# EasyEDA Pro project 智能母版V4.eprj, board PCB1 (continued)
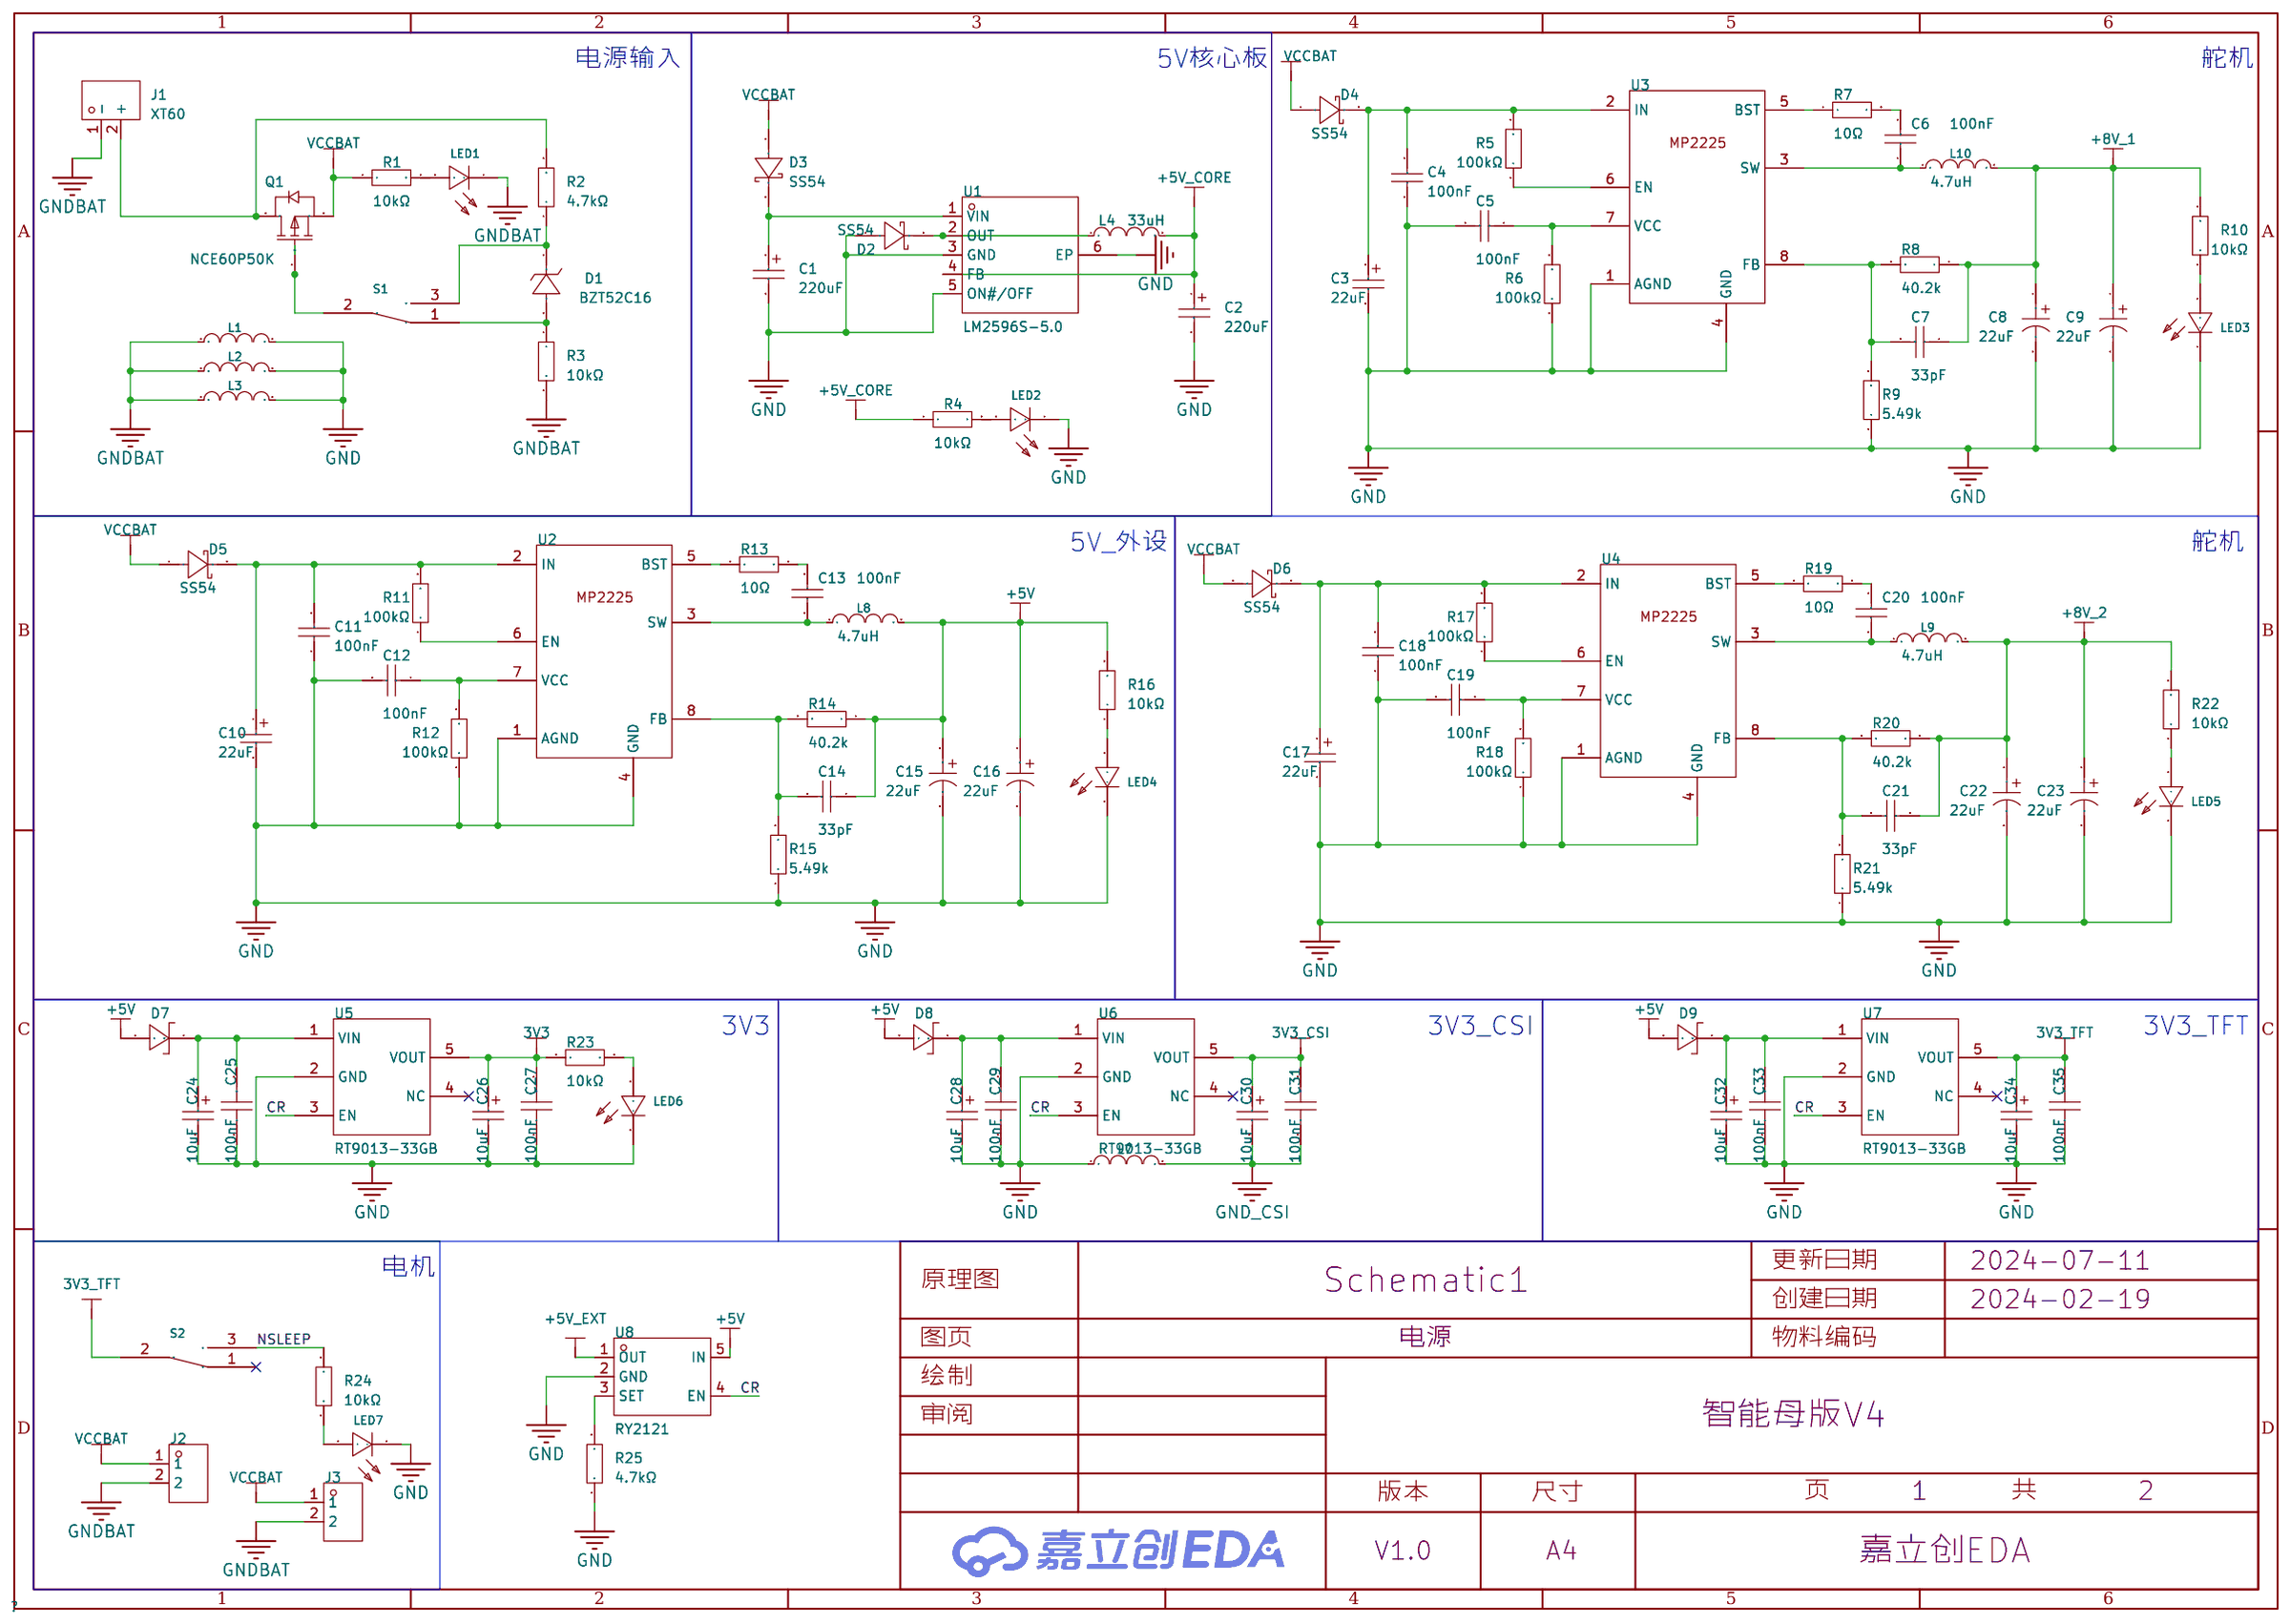
[diagram p0: 电源]
## Routing (per net, layer and track width the routed paths; a pad name or vN(x,y) marks a point on that pad's centre or on a via; arc(x,y) is an arc through that point) (continued)
  Top Layer w0.508: 17.04,37.08 v1(18.41,37.08)
  Top Layer w0.762: H10.2 H12.2 4.83,59.56 5.33,60.07 8.76,60.07 9.53,59.31 9.53,54.74 9.96,54.3 H11.2
  Bottom Layer w0.762: v1(18.41,37.08) 18.41,42.42 16,44.83 11.05,44.83 4.83,51.05 H10.2
+8V_2: length 25.7
  Top Layer w0.381: 24.49,52.8 24.51,52.78 24.51,48.51 23.74,47.74 R20.1 22.65,47.68 C21.1
  Top Layer w0.762: R22.2 18.05,54.1 ; 26.96,66.42 30.23,66.42 33.4,69.6 v1(33.4,77.34)
GND: length 198.1
  Top Layer w0.203: U10.1 v1(73.15,38.61) ; v1(62.1,56.01) 62.97,56.01 63,56.04 ; F1.12 69.44,82.77 v1(69.09,82.42) ; v1(80.01,38.1) 80.01,37.46 79.79,37.24 U10.13 ; R31.2 R30.2 v1(67.69,55.5) 68.58,55.5 68.98,55.1 C36.1 ; U9.7 v1(58.17,52.79) ; U9.10 v1(61.85,54.09) ; U10.4 v1(74.29,35.94) ; v1(70.49,43.69) v1(72.52,43.69) ; v1(75.69,89.03) v1(75.69,86.87) ; U10.10 v1(80.14,35.29) 81.65,35.29 82.15,35.79 R34.2 ; U10.7 v1(74.29,33.99) ; R33.2 v1(69.86,36.18) R32.2 ; U9.1 56.47,56.69 56.01,57.15 v1(54.61,57.15) 54.1,57.15 53.86,56.9 R29.2 52.83,55.88 52.32,55.37 52.32,54.74 52.95,54.11 R28.2 54.61,54.86 56.13,54.86 56.26,54.74 U9.4
  Top Layer w0.381: R21.1 v1(18.03,44.58) ; 7.87,37.59 8,37.72 v1(8,39.62) ; LED4.1 v1(34.66,18.41) ; LED2.1 v1(21.15,65.4) ; 18.92,50.34 v1(18.92,48.89) ; C9.2 v1(14.34,35.06) 14.35,35.05 ; R15.1 v1(19.18,23.88) ; C19.2 v1(19.5,38.35) ; R9.1 v1(1.65,46.74) ; C39.1 60.28,69.64 60.77,69.15 H6.2 ; LED7.1 v1(12.97,20.19) ; Q2.2 v1(38.37,51.18)
  Top Layer w0.508: LED8.1 14.19,88.94 15.75,87.38 17.69,87.38 ; C33.1 44.7,8.08 C32.2 ; C33.1 46.69,8.08 47.21,8.6 U7.2 ; C33.1 v1(46.35,6.6) ; 42.7,16.51 C29.1 ; 42.7,16.51 41.78,16.51 41.19,15.92 C28.2 ; 42.7,16.51 42.76,16.51 ; L7.1 45.32,14.97 45.59,15.24 45.59,16.76 45.09,17.27 U6.2 43.56,17.27 42.8,16.51 42.76,16.51 ; U8.2 40.17,13.04 40.77,12.45 41.38,12.45 41.4,12.47 v1(42.67,12.47) ; LED3.1 16.59,44.49 15.11,45.97 15.11,47.35 H15.3 ; v1(55.75,8.08) C35.1 53.93,8.08 53.42,7.57 C34.2 ; C25.1 42.06,79.74 C24.2 ; C25.1 42.75,79.82 43.16,80.23 47.66,80.23 48.01,79.88 C26.2 48.51,79.51 v1(49.09,79.51) C27.1 50.43,79.24 LED6.1 ; C25.1 42.29,79.67 v1(42.29,78.49) ; 42.76,16.51 v1(42.76,15.24) ; C38.1 C37.1 76.77,54.67 77.09,54.36 v1(77.72,54.36)
  Top Layer w0.762: LED5.1 22.73,55.88 v1(22.73,54.99) ; U1.3 v1(11.56,75.36) ; U1.5 8.94,70.56 9.27,70.23 v1(11.05,70.23)
  Top Layer w0.889: L3.2 L2.2 L1.2 17.27,29.44 v1(17.27,31.5)
  Bottom Layer w0.203: v1(38.35,66.17) 38.35,63.88 v1(38.61,63.63) ; v1(31.75,47.62) 33.53,47.62 v1(34.16,46.99) ; v1(44.32,38.99) v1(42.16,38.99) v1(39.24,38.99) ; v1(28.57,28.83) 30.23,27.18 v1(30.23,26.8) ; v1(56.01,23.49) v1(58.14,23.49) v1(60.2,23.49) ; v1(32.38,41.4) v1(37.85,41.4) ; v1(60.58,43.94) v1(65.41,43.94) v1(67.82,43.94) 70.23,43.94 v1(70.49,43.69) ; v1(52.45,46.23) v1(54.36,46.23) ; v1(60.32,63.5) v1(60.32,65.79) ; v1(63.88,71.5) v1(63.88,74.68) ; v1(60.07,34.04) v1(57.4,34.04) ; v1(2.16,42.42) v1(7.11,42.42) ; v1(65.28,65.4) 65.79,64.9 v1(65.79,63.63) ; v1(30.86,38.61) v1(32.26,37.21)
  Bottom Layer w0.381: v1(1.65,46.74) 1.65,42.93 v1(2.16,42.42) ; v1(8,39.62) 10.03,39.62 11.81,37.85 11.81,35.56 12.32,35.05 14.33,35.05 v1(14.34,35.06) ; v1(12.97,20.19) 15.75,20.19 17.4,21.84 v1(18.54,21.84)
  Bottom Layer w0.508: D2.1 v1(12.44,70.48)
  vias: v1(14.99,61.85) v1(14.99,59.05) v1(15.45,80.26) v1(15.45,75.36) v1(15.45,70.24) v1(17.81,75.36) v1(19.97,75.36) v1(20.94,19.18) v1(23.11,80.26) v1(23.11,70.36) v1(23.18,75.36) v1(24.34,15.9) v1(24.34,15.12) v1(24.34,14.36) v1(24.34,13.58) v1(26.92,86.99) v1(26.92,85.72) v1(30.6,8.82) v1(31.57,8.82) v1(32.56,8.82)
GND_CSI: length 40.8
  Top Layer w0.508: C31.1 50.42,16.06 v1(49.86,16.06) C30.2 48.77,13.84 48.64,13.72 47.25,13.72
  GND w0.381: v1(49.86,16.06) 51.69,16.06 52.07,16.45 52.07,26.16 51.18,27.05 47.75,27.05 46.98,26.28 H1.3
  Bottom Layer w0.203: H1.3 46.98,23.36 46.81,23.19 34.47,23.19 34.28,23.38 H1.13
GNDBAT: length 1.2
  Top Layer w0.889: LED1.1 22.07,8.51 v1(23.24,8.51)
  vias: v1(13.72,29.34)
VCCBAT:
  vias: v1(6.98,62.99) v1(9.02,35.31) v1(9.02,33.27) v1(9.38,62.76) v1(24.76,9.65) v1(25.74,9.65) v1(26.54,9.65) v1(27.69,32.51) v1(27.81,30.48)
B0: length 35.9
  Top Layer w0.203: F1.11 70.94,74.11 69.98,73.15 57.02,73.15 53.59,69.72 v1(53.59,65.53)
  Bottom Layer w0.203: v1(53.59,65.53) 53.59,64.9 52.45,63.75 52.45,62.1
B1: length 43.9
  Top Layer w0.203: v1(56.26,58.42) 52.71,58.42 52.45,58.67 U11.24 ; F1.10 71.94,79.81 71.5,79.37 71.5,72.9 71.25,72.64 57.15,72.64 56.26,71.75 v1(56.26,65.28)
  Bottom Layer w0.203: v1(56.26,65.28) v1(56.26,58.42)
B2: length 40.3
  Top Layer w0.203: v1(69.85,80.01) 69.85,75.18 68.33,73.66 56.01,73.66 53.09,70.74 53.09,66.42 51.94,65.28 v1(50.8,65.28) ; 49.91,62.1 49.91,63.75 50.16,64.01 v1(50.8,64.01) ; F1.9 v1(72.94,80.01)
  Bottom Layer w0.203: v1(50.8,65.28) v1(50.8,64.01) ; v1(72.94,80.01) v1(69.85,80.01)
B3: length 45.3
  Top Layer w0.203: v1(48.77,64.01) v1(48.77,61.59) ; F1.7 74.94,83.87 74.74,84.07 69.88,84.07 66.45,80.64 57.78,80.64 50.67,73.53 v1(50.67,71.5)
  Bottom Layer w0.203: U11.26 49.91,60.58 49.66,60.83 49.15,60.83 48.77,61.21 v1(48.77,61.59) ; v1(48.77,64.01) 48.77,64.52 50.67,66.42 v1(50.67,71.5)
B9: length 55.2
  Top Layer w0.203: v1(37.21,46.23) 37.21,31.62 ; v1(29.59,54.99) 29.59,62.1 32.38,64.9 43.05,64.9 44.47,66.31 CN1.3
  Bottom Layer w0.203: v1(29.59,54.99) 29.59,48.39 31.75,46.23 v1(37.21,46.23)
B10: length 52.7
  Top Layer w0.203: CN1.4 46.97,65.13 46.15,64.31 34.47,64.31 33.4,63.25 v1(33.4,40.26)
  Bottom Layer w0.203: U11.48 34.54,28.96 33.78,28.96 33.4,29.34 v1(33.4,40.26)
B11: length 56.6
  Top Layer w0.203: v1(57.4,44.7) v1(57.4,38.48) ; U10.2 73.12,37.21 72.26,37.21 72.14,37.08 R33.1 70.74,37.08 70.61,37.21 v1(70.61,38.48)
  Bottom Layer w0.203: U11.47 34.67,32.89 34.93,33.15 36.07,33.15 36.58,33.65 36.58,35.56 35.31,36.83 35.31,37.97 39.12,41.78 50.8,41.78 51.44,42.42 52.96,42.42 55.25,44.7 v1(57.4,44.7) ; v1(70.61,38.48) v1(57.4,38.48)
B11_A: length 84.1
  Top Layer w0.203: v1(37.97,48.39) 39.75,48.39 v1(41.91,46.23) ; v1(74.29,40.26) 74.29,36.83 74.06,36.59 73.15,36.59 ; v1(72.26,40.89) v1(70.49,40.89) ; v1(15.11,56.01) 15.11,52.47 H15.1 ; v1(46.61,40.51) v1(46.61,46.23) ; v1(32.64,44.96) v1(32.64,49.4)
  Bottom Layer w0.203: v1(74.29,40.26) 73.66,40.89 v1(72.26,40.89) ; v1(32.64,49.4) 34.29,49.4 35.31,48.39 v1(37.97,48.39) ; v1(15.11,56.01) 15.92,56.01 26.97,44.96 v1(32.64,44.96) ; v1(46.61,40.51) 48.01,40.51 48.26,40.26 57.91,40.26 58.29,40.64 70.23,40.64 v1(70.49,40.89) ; v1(41.91,46.23) v1(46.61,46.23)
B12: length 55.3
  Top Layer w0.203: 58.59,13.59 58.59,17.49 57.53,18.54 57.53,25.27 56.51,26.29 56.51,47.24 v1(50.42,53.34)
  Bottom Layer w0.203: v1(50.42,53.34) 50.42,57.28 48.64,59.05 48.64,60.07 48.01,60.71 47.35,60.71 45.95,62.1 44.83,62.1
B13: length 63.9
  Top Layer w0.203: CN2.3 61.09,12.06 60.58,11.56 58.04,11.56 57.4,12.19 57.4,16.38 53.72,20.07 53.72,48.51 51.18,51.05
  Bottom Layer w0.203: 47.37,62.1 47.37,63.17 47.57,63.37 50.67,63.37 51.05,62.99 v1(51.05,51.18)
B14: length 51.8
  Top Layer w0.203: v1(45.85,61.34) v1(45.85,63.12) ; v1(45.72,69.85) 47.24,69.85 49.78,72.39 49.78,73.41 57.4,81.03 66.29,81.03 69.85,84.58 77.6,84.58 77.94,84.24 F1.4
  Bottom Layer w0.203: U11.30 45.72,59.56 45.85,59.69 v1(45.85,61.34) ; v1(45.85,63.12) 45.72,63.25 v1(45.72,69.85)
B15: length 29
  Top Layer w0.203: CN1.6 51.97,70.2 51.44,70.74 48.9,70.74 48.26,70.1 48.26,65.02 46.99,63.75 v1(43.56,63.75)
  Bottom Layer w0.203: v1(43.56,63.75) 43.56,57.53 43.94,57.15 46.86,57.15 47.37,57.66 47.37,59.56
B16: length 92.2
  Top Layer w0.203: H4.3 61.09,7.24 v1(62.36,8.51) ; v1(42.29,57.15) v1(42.29,47.12)
  Bottom Layer w0.203: v1(42.29,57.15) U11.32 ; v1(62.36,8.51) 62.36,23.62 63.12,24.38 70.87,24.38 71.5,25.02 71.5,45.72 70.1,47.12 v1(42.29,47.12)
B17: length 109.1
  Top Layer w0.203: 42.29,62.1 42.29,61.09 42.8,60.58 v1(53.85,60.58) ; H4.4 61.09,0.89 61.47,0.51 64.52,0.51 64.9,0.89 64.9,6.86 67.06,9.02 75.06,9.02 77.22,11.18 77.22,24.26 79.12,26.16 v1(79.12,33.27)
  Bottom Layer w0.203: v1(79.12,33.27) 79.12,46.86 78.36,47.62 60.71,47.62 53.85,54.48 v1(53.85,60.58)
B18: length 50.2
  Top Layer w0.203: CN3.4 58.77,46.01 46.86,57.91 40.26,57.91 39.75,58.42 U11.34
B19: length 54
  Top Layer w0.203: 39.75,62.1 40.64,62.1 41.02,61.72 41.02,58.8 41.4,58.42 47.37,58.42 61.27,44.52 CN3.3
B20: length 38.5
  Top Layer w0.203: H1.15 31.74,27.19 30.48,28.45 30.48,36.32 35.76,41.6 35.76,55.32 37.21,56.77 37.21,59.56
B21: length 9.1
  Top Layer w0.203: R27.1 38.62,61.71 38.23,62.1 37.21,62.1
B22: length 41.2
  Top Layer w0.203: v1(36.96,55.24) 36.96,48.01 37.21,47.75 39.5,47.75 43.31,43.94 43.31,27.69 44.44,26.55 H1.5
  Bottom Layer w0.203: v1(36.96,55.24) 36.96,57.28 35.94,58.29 35.94,59.31 35.69,59.56 U11.38
B23: length 63.5
  Top Layer w0.203: v1(54.74,79.63) 56.51,81.41 66.17,81.41 69.72,84.96 78.23,84.96 78.94,84.26 F1.3
  Bottom Layer w0.203: v1(54.74,79.63) 54.74,73.41 53.47,72.14 38.61,72.14 36.58,70.1 36.58,64.01 36.32,63.75 35.05,63.75 34.67,63.37 34.67,62.1
B24: length 60.5
  Top Layer w0.203: U11.40 31.24,59.56 30.84,59.16 30.84,43.84 v1(30.86,43.81) ; H1.2 50.8,21.84 51.18,22.22 v1(51.18,43.81)
  Bottom Layer w0.203: v1(51.18,43.81) v1(30.86,43.81)
B25: length 61.3
  Top Layer w0.203: v1(30.23,42.42) 30.23,61.34 30.99,62.1 32.13,62.1 ; v1(48.51,42.42) 48.46,42.37 48.46,26.62 48.26,26.42 48.26,21.97 48.13,21.84 H1.4
  Bottom Layer w0.203: v1(48.51,42.42) v1(30.23,42.42)
B26: length 56.8
  Top Layer w0.203: H1.6 45.59,21.84 45.72,21.97 45.72,27.18 45.92,27.38 45.92,56.51
  Bottom Layer w0.203: v1(45.97,56.51) 39.62,56.51 38.61,57.53 38.61,60.45 38.23,60.83 33.66,60.83 33.4,60.58 33.4,57.28 33.15,57.02 32.13,57.02
B27: length 41.8
  Top Layer w0.203: H1.8 40.77,21.84 40.64,21.97 v1(40.64,26.03) ; v1(40.64,27.94) 40.64,28.57 41.15,29.08 41.15,44.7 38.99,46.86 v1(36.7,46.86) ; v1(34.04,48.39) v1(34.04,54.74)
  Bottom Layer w0.203: 34.67,57.02 34.67,55.37 v1(34.04,54.74) ; v1(40.64,26.03) v1(40.64,27.94) ; v1(34.04,48.39) 35.56,46.86 v1(36.7,46.86)
B28: length 14.2
  Top Layer w0.203: v1(38.1,26.16) 38.1,22.1 38.35,21.84 H1.10
  Bottom Layer w0.203: U11.46 32.13,26.42 32.38,26.16 v1(38.1,26.16)
B29: length 22.9
  Top Layer w0.203: v1(29.59,31.62) 29.59,20.57 30.35,19.81 36.45,19.81 36.82,20.18 H1.12
  Bottom Layer w0.203: v1(29.59,31.62) U11.45
B30: length 20.9
  Top Layer w0.203: U11.43 32.13,35.56 33.02,36.45 35.05,36.45 35.94,35.56 35.94,27.56 35.56,27.18 35.56,22.1 35.31,21.84 H1.14
B31: length 14.2
  Top Layer w0.203: U11.44 34.67,33.15 33.4,31.88 33.4,27.05 33.02,26.67 33.02,21.97 32.89,21.84 H1.16
C0: length 94.5
  Top Layer w0.203: v1(83.06,27.94) v1(83.06,63.5) ; v1(69.09,79.12) v1(63.75,79.12)
  Bottom Layer w0.203: v1(69.09,79.12) 69.09,71.37 69.6,70.87 76.45,70.87 77.6,69.72 77.6,65.66 78.1,65.15 81.41,65.15 v1(83.06,63.5) ; v1(63.75,79.12) 63.75,80.77 62.48,82.04 49.53,82.04 48.64,82.93 H3.3 ; U11.82 77.85,28.19 78.1,27.94 v1(83.06,27.94)
C1: length 100.8
  Top Layer w0.203: H3.4 48.64,86.87 48.9,86.61 53.21,86.61 54.23,85.6 54.23,84.2 54.53,83.9 66.09,83.9 66.55,83.44 v1(66.55,82.8) ; v1(85.34,32.64) v1(85.34,77.47)
  Bottom Layer w0.203: U11.79 75.31,32.38 75.56,32.64 v1(85.34,32.64) ; v1(66.55,82.8) 66.55,81.28 67.06,80.77 84.46,80.77 85.34,79.88 v1(85.34,77.47)
C2: length 100.3
  Top Layer w0.203: v1(84.46,26.42) 84.46,65.28 83.31,66.42 81.53,66.42 79.25,68.71 79.25,72.14 83.19,76.07 v1(83.19,81.41)
  Bottom Layer w0.203: U11.80 75.31,26.92 75.82,26.42 v1(84.46,26.42) ; H2.3 60.71,86.36 61.09,86.74 68.96,86.74 69.98,87.76 80.65,87.76 83.19,85.22 v1(83.19,81.41)
C3: length 28.8
  Top Layer w0.203: v1(73.66,8.25) H5.3
  Bottom Layer w0.203: v1(73.66,8.25) 74.8,9.4 74.8,24.64 73.78,25.67 73.78,31.42 73.57,31.62 U11.77
C6: length 10.2
  Top Layer w0.203: v1(70.87,32.77) 71.5,32.13 71.5,29.34 71.25,29.08 U11.76 ; v1(70.61,34.42) 70.61,35.18 70.74,35.31 R32.1 73.13,35.31 U10.5
  Bottom Layer w0.203: v1(70.87,32.77) 70.61,33.02 v1(70.61,34.42)
C6_A: length 95.4
  Top Layer w0.203: H14.1 20.57,62.61 20.19,62.23 20.19,58.8 19.69,58.29 17.02,58.29 16.76,58.04 v1(16.76,56.26) ; v1(63.88,51.76) 75.74,51.76 75.95,51.56 75.95,35.31 75.28,34.64 U10.6 ; v1(55.37,51.94) v1(60.96,51.94)
  Bottom Layer w0.203: v1(16.76,56.26) 29.97,56.26 30.61,55.63 30.61,51.87 31.88,50.6 36.07,50.6 37.01,49.66 53.09,49.66 v1(55.37,51.94) ; v1(63.88,51.76) 63.7,51.94 v1(60.96,51.94)
C11: length 103.3
  Top Layer w0.203: H8.1 39.75,87.88 44.32,83.31 v1(65.53,83.31) ; v1(77.72,51.82) v1(77.72,42.04) ; U11.69 62.48,31.75 62.48,33.4 62.99,33.91 66.8,33.91 67.18,34.29 67.18,36.19 68.2,37.21 68.2,39.75 70.49,42.04 v1(72.26,42.04)
  Bottom Layer w0.203: v1(77.72,51.82) 76.58,52.96 76.58,64.39 75.82,65.15 68.33,65.15 67.18,66.29 67.18,69.72 65.53,71.37 v1(65.53,83.31) ; v1(77.72,42.04) v1(72.26,42.04)
C16: length 27.2
  Top Layer w0.203: CN4.4 70.83,14.76 68.2,17.4 68.2,26.03 66.68,27.56 v1(62.74,27.56)
  Bottom Layer w0.203: v1(62.74,27.56) 57.91,27.56 57.53,27.94 U11.66
C17: length 34.1
  Top Layer w0.203: v1(64.01,33.27) 68.71,33.27 68.96,33.02 68.96,27.3 70.61,25.65 70.61,17.65 71,17.26 CN4.3
  Bottom Layer w0.203: U11.63 54.99,32.77 55.5,33.27 v1(64.01,33.27)
C18: length 83.3
  Top Layer w0.203: v1(77.72,39.24) 79.12,39.24 82.04,42.16 82.04,62.99 81.15,63.88 79.76,63.88 78.74,64.9 78.74,78.36 75.94,81.16 F1.6 ; v1(54.99,39.12) 54.99,34.42 56.13,33.27 56.13,31.11 54.99,29.97 U11.64 ; v1(72.26,39.24) v1(70.61,39.24)
  Bottom Layer w0.203: v1(54.99,39.12) 70.49,39.12 v1(70.61,39.24) ; v1(77.72,39.24) v1(72.26,39.24)
C19: length 78.6
  Top Layer w0.203: v1(52.45,41.78) U11.61 ; v1(61.47,45.85) 61.47,48.26 v1(61.59,48.39) ; F1.8 73.94,80.75 74.29,80.39 76.2,80.39 78.23,78.36 78.23,64.26 79.12,63.37 v1(79.12,48.39)
  Bottom Layer w0.203: v1(52.45,41.78) 55.37,41.78 59.44,45.85 v1(61.47,45.85) ; v1(79.12,48.39) v1(61.59,48.39)
C20: length 59.4
  Top Layer w0.203: v1(74.04,49.53) 74.04,41.27 72.64,39.88 70.36,39.88 68.83,38.35 v1(68.83,36.58) ; v1(64.39,36.58) v1(64.39,34.8) ; v1(74.04,53.34) 74.04,62.74 70.93,65.85 H6.6
  Bottom Layer w0.203: v1(68.83,36.58) v1(64.39,36.58) ; U11.62 53.72,29.08 53.97,29.34 53.97,33.91 54.86,34.8 v1(64.39,34.8) ; v1(74.04,53.34) v1(74.04,49.53)
C21: length 60.6
  Top Layer w0.203: H6.5 68.39,66.11 71.5,62.99 71.5,58.93 72.9,57.53 v1(72.9,53.34) ; v1(50.55,36.58) 50.55,33.65 49.91,33.02 U11.59 ; v1(63.12,36.58) v1(63.12,49.53)
  Bottom Layer w0.203: v1(63.12,36.58) v1(50.55,36.58) ; v1(72.9,53.34) 72.9,49.91 72.52,49.53 v1(63.12,49.53)
C22: length 58.2
  Top Layer w0.203: v1(67.31,51.18) 67.18,51.05 v1(67.18,37.72) ; v1(66.42,65.28) 65.85,65.85 65.85,67.94 ; v1(49.91,37.72) 49.91,34.29 48.8,33.18 48.8,29.3 49.02,29.08 U11.60
  Bottom Layer w0.203: v1(67.18,37.72) v1(49.91,37.72) ; v1(67.31,51.18) 67.31,52.07 66.42,52.96 v1(66.42,65.28)
C23: length 66.6
  Top Layer w0.203: v1(63.31,63.57) 63.31,63.06 63.88,62.48 63.88,58.67 62.99,57.78 52.45,57.78 51.56,56.9 51.56,54.86 61.98,44.45 v1(61.98,39.88) ; v1(47.5,39.75) 47.5,31.75 47.37,31.62 ; H6.3 v1(63.31,65.53)
  Bottom Layer w0.203: v1(47.5,39.75) 61.85,39.75 v1(61.98,39.88) ; v1(63.31,65.53) v1(63.31,63.57)
C24: length 102.6
  Top Layer w0.203: v1(68.58,51.18) v1(68.58,42.16) ; v1(68.33,81.53) v1(68.33,79.88) ; v1(69.72,65.91) v1(71.88,63.75) ; v1(70.87,86.74) 70.87,89.28 70.61,89.53 60.96,89.53 60.71,89.28 H2.4 ; 47.37,29.08 47.37,30.2 46.35,31.22 46.35,32.77 46.74,33.15 v1(46.74,36.19)
  Bottom Layer w0.203: v1(71.88,63.75) 69.72,63.75 68.96,62.99 68.96,52.7 68.58,52.32 v1(68.58,51.18) ; v1(68.58,42.16) 57.15,42.16 56.21,41.22 45.92,41.22 45.09,40.39 45.09,36.58 45.47,36.19 v1(46.74,36.19) ; v1(68.33,79.88) 68.33,70.74 69.72,69.34 v1(69.72,65.91) ; v1(70.87,86.74) 70.87,82.3 70.1,81.53 v1(68.33,81.53)
C25: length 80.2
  Top Layer w0.203: v1(67.82,35.56) 69.98,33.4 v1(72.52,33.4) ; H5.4 73.66,0.89 73.91,0.63 77.6,0.63 77.98,1.02 77.98,23.62 81.91,27.56 v1(81.91,30.35)
  Bottom Layer w0.203: v1(72.52,33.4) 73.53,33.4 74.17,32.77 74.17,30.99 74.8,30.35 v1(81.91,30.35) ; v1(67.82,35.56) 45.97,35.56 44.83,34.42 U11.55
C26: length 95.1
  Top Layer w0.203: U11.56 44.83,30.1 43.69,31.24 v1(43.69,45.47) ; v1(75.06,51.05) 69.98,51.05 69.22,50.29 v1(69.22,46.48) ; v1(79.88,77.32) 79.88,80.31 R26.1 79.94,80.37 F1.2
  Bottom Layer w0.203: v1(43.69,45.47) 57.66,45.47 58.67,46.48 v1(69.22,46.48) ; v1(75.06,51.05) 81.53,51.05 83.95,53.47 83.95,64.39 82.42,65.91 80.9,65.91 79.25,67.56 79.25,76.71 79.88,77.34
C27: length 41.6
  Top Layer w0.203: H7.5 v1(52.96,2.03) ; v1(52.96,27.56) v1(52.96,13.72)
  Bottom Layer w0.203: U11.53 42.29,30.73 42.42,30.61 50.04,30.61 50.93,29.72 50.93,28.32 51.69,27.56 v1(52.96,27.56) ; v1(52.96,2.03) v1(52.96,13.72)
C28: length 6.5
  Top Layer w0.203: H1.9 39.36,25.77 40.64,27.05 41.66,27.05 42.29,27.69 U11.54
C29: length 8.5
  Top Layer w0.203: H1.11 36.82,26.15 38.74,28.07 38.74,29.49 39.75,30.5 U11.51
C30: length 42.4
  Top Layer w0.203: H7.1 44.2,2.03 43.56,2.67 v1(43.56,6.1)
  Bottom Layer w0.203: U11.52 39.75,29.46 40.37,30.09 48.02,30.09 48.39,29.72 48.39,27.05 48.21,26.87 48.21,20.9 47.75,20.45 44.7,20.45 43.56,19.3 v1(43.56,6.1)
C31: length 72.6
  Top Layer w0.203: v1(36.45,45.59) 36.45,36.96 v1(36.32,36.83) ; H8.5 34.04,87.88 34.29,87.63 34.29,83.06 36.07,81.28 36.07,70.87 28.83,63.63 v1(28.83,54.99)
  Bottom Layer w0.203: 37.21,29.08 38.1,29.08 38.35,29.34 38.35,36.32 37.85,36.83 v1(36.32,36.83) ; v1(28.83,54.99) 28.83,48.13 31.37,45.59 v1(36.45,45.59)
CR: length 170.2
  Top Layer w0.203: 43.96,13.97 43.96,12.3 44.58,11.68 48.64,11.68 49.66,10.67 49.66,8.13 49.18,7.65 U7.3 ; 43.96,13.97 42.93,13.97 42.04,14.86 37.47,14.86 37.05,14.45 U8.4 ; 43.96,13.97 44.58,14.59 v1(44.58,15.6) 44.58,16.31 U6.3 ; R35.2 R36.2 71.26,55.26 70.99,54.99 70.99,54.1 C36.2 71.99,54.08 72.26,54.36 v1(72.26,54.99) ; 43.99,79.28 v1(43.99,78.61) ; v1(59.94,44.58) v1(59.94,41.53)
  PWR w0.203: v1(52.07,77.09) 52.07,75.69 54.86,72.9 76.71,72.9 77.47,72.14 77.47,66.42 76.58,65.53 76.58,58.17 75.82,57.4 74.68,57.4 v1(72.26,54.99) 70.1,54.99 69.72,54.61 65.15,54.61 64.9,54.86 60.85,54.86 59.94,53.96 59.94,51.43 62.87,48.51 69.72,48.51 70.49,47.75 70.49,45.47 69.6,44.58 v1(59.94,44.58) ; v1(59.94,41.53) 59.44,41.53 58.8,40.89 58.8,26.8 57.02,25.02 53.97,25.02 53.59,24.64 53.59,19.05 53.47,18.92 50.42,18.92 49.53,19.81 v1(47.12,19.81)
  Bottom Layer w0.203: v1(47.12,19.81) 45.59,19.81 44.58,18.8 v1(44.58,15.6) ; v1(52.07,77.09) 50.42,77.09 49.91,77.6 44.32,77.6 43.99,77.93 v1(43.99,78.61)
D0: length 13.9
  Top Layer w0.203: U11.14 65.15,58.42 64.01,57.28 59.06,57.28 58.04,56.26 58.04,54.36 57.78,54.1 57.16,54.1 U9.5 57.12,54.11 R28.1
D0_A: length 63.8
  Top Layer w0.203: v1(54.36,52.96) 55.75,52.96 56.23,53.44 U9.6
  Bottom Layer w0.203: v1(54.36,52.96) 53.09,52.96 52.32,52.2 52.32,50.67 51.82,50.16 37.08,50.16 36.32,50.93 32.13,50.93 31.12,51.94 31.12,55.75 29.97,56.9 14.48,56.9 13.21,55.63 2.67,55.63 2.29,55.24 H10.1
D1: length 12.8
  Top Layer w0.203: U9.9 63.03,53.47 64.01,53.47 64.26,53.72 R31.1 v1(65.66,53.72)
  Bottom Layer w0.203: v1(65.66,53.72) 65.66,54.48 65.02,55.12 65.02,57.45 63.88,58.6 63.88,60.45 64.26,60.83 64.9,60.83 65.15,61.09 65.15,62.1
D1_A: length 62
  Top Layer w0.203: H11.1 13.52,56.84 14.1,56.26 v1(14.1,55.24) ; U9.8 63,51.06 61.85,49.91 60.83,49.91 v1(59.18,48.26)
  Bottom Layer w0.203: v1(14.1,55.24) 16.26,55.24 27.13,44.37 38.41,44.37 42.29,48.26 v1(59.18,48.26)
D2: length 16.9
  Top Layer w0.203: v1(64.01,56.64) 66.8,56.64 67.69,57.53 U11.12 ; R29.1 56.13,55.88 v1(56.26,56.01) 57.12,56.01 57.15,56.04 ; v1(60.71,56.64) v1(59.31,56.64)
  Bottom Layer w0.203: v1(56.26,56.01) 56.26,56.77 56.77,57.28 58.67,57.28 v1(59.31,56.64) ; v1(60.71,56.64) v1(64.01,56.64)
D2_A: length 66.1
  Top Layer w0.203: U9.3 56.06,55.39 55.86,55.18 53.03,55.18 v1(52.96,55.12) ; v1(51.69,58.04) v1(48.64,58.04)
  Bottom Layer w0.203: v1(48.64,58.04) 48.64,56.01 47.88,55.24 38.99,55.24 37.59,53.85 33.89,53.85 30.46,57.28 14.35,57.28 10.67,60.96 2.79,60.96 2.29,60.45 H12.1 ; v1(52.96,55.12) 52.96,57.4 52.32,58.04 v1(51.69,58.04)
D3: length 10.7
  Top Layer w0.203: v1(65.66,55.5) R30.1 63.88,55.5 63.75,55.37 63.01,55.37 U9.12 ; 67.69,62.1 66.8,62.1 66.42,61.72 66.42,58.17 v1(65.79,57.53)
  Bottom Layer w0.203: v1(65.66,55.5) 65.66,57.4 v1(65.79,57.53)
D3_A: length 53.2
  Top Layer w0.203: v1(58.8,51.31) v1(56.01,51.31) ; v1(24.13,55.63) 24.13,57.28 23.62,57.78 22.1,57.78 21.95,57.93 H13.1 ; U9.11 v1(58.8,54.74)
  Bottom Layer w0.203: v1(56.01,51.31) 53.97,49.28 36.7,49.28 35.69,50.29 31.62,50.29 30.23,51.69 30.23,55.24 29.84,55.63 v1(24.13,55.63) ; v1(58.8,54.74) v1(58.8,51.31)
D4: length 27.7
  Top Layer w0.203: CN1.5 49.47,65.72 50.55,64.64 67.56,64.64 68.96,63.25 68.96,59.82 69.22,59.56 U11.10
D12: length 49.7
  Top Layer w0.203: v1(64.64,82.68) 43.81,82.68 41.15,85.34 H8.2
  Bottom Layer w0.203: v1(64.64,82.68) 64.64,63.12 63.63,62.1 62.61,62.1
D13: length 56
  Top Layer w0.203: v1(33.02,81.66) H8.6 ; v1(61.34,64.01) 61.34,59.94 61.72,59.56 U11.16
  Bottom Layer w0.203: v1(61.34,64.01) 61.72,64.01 62.1,64.39 62.1,71.75 62.87,72.52 62.87,79.12 60.32,81.66 v1(33.02,81.66)
D14: length 94.2
  Top Layer w0.203: v1(64.64,52.7) 75.44,52.7 76.45,51.69 76.45,11.56 74.8,9.91 59.82,9.91 54.48,4.57 H7.6
  Bottom Layer w0.203: v1(64.64,52.7) 64.64,57.15 64.01,57.78 62.1,57.78 61.34,58.55 61.34,61.85 61.09,62.1 60.07,62.1
D15: length 76.4
  Top Layer w0.203: v1(66.55,34.67) v1(66.55,51.18) ; H7.2 v1(45.47,6.6)
  Bottom Layer w0.203: v1(66.55,34.67) 66.55,27.3 65.91,26.67 54.61,26.67 52.45,24.51 52.45,15.62 45.47,8.64 v1(45.47,6.6) ; v1(66.55,51.18) 60.71,51.18 60.07,51.82 U11.18
D16: length 30.6
  Top Layer w0.203: v1(55.63,66.04) v1(55.63,67.94) ; v1(49.91,75.31) 41.4,75.31 41.02,74.93 H9.1 ; v1(55.63,75.31) v1(53.97,75.31)
  Bottom Layer w0.203: v1(55.63,75.31) v1(55.63,67.94) ; v1(55.63,66.04) 57.02,66.04 57.53,65.53 57.53,62.1 ; v1(49.91,75.31) v1(53.97,75.31)
D17: length 27.4
  Top Layer w0.203: v1(46.86,70.74) 43.94,70.74 43.56,71.12 H9.3 ; v1(51.31,69.85) v1(49.15,69.85)
  Bottom Layer w0.203: v1(46.86,70.74) 48.26,70.74 v1(49.15,69.85) ; v1(51.31,69.85) 52.71,69.85 56.01,66.55 57.78,66.55 58.8,65.53 58.8,59.82 58.55,59.56 U11.20
D26: length 88.7
  Top Layer w0.203: v1(80.65,41.66) 81.41,42.42 v1(81.41,52.2) ; v1(52.71,77.98) 44.07,77.98 43.56,77.47 H9.4 ; v1(62.23,78.74) 65.53,75.44 v1(67.06,75.44) ; v1(67.06,71.12) 74.8,71.12 77.34,68.58 v1(77.34,64.13) ; v1(81.53,33.53) 81.53,31.35 80.39,30.2 U11.84
  Bottom Layer w0.203: v1(80.65,41.66) 80.65,36.45 81.53,35.56 v1(81.53,33.53) ; v1(67.06,75.44) v1(67.06,71.12) ; v1(77.34,64.13) 80.52,64.13 81.41,63.25 v1(81.41,52.2) ; v1(62.23,78.74) 60.58,80.39 53.21,80.39 52.71,79.88 v1(52.71,77.98)
D27: length 8.3
  Top Layer w0.203: R34.1 77.61,36.59 77.34,36.32 77.34,32.13 U11.81
D27_A: length 102
  Top Layer w0.203: v1(35.18,49.66) 35.18,55.63 35.81,56.26 35.81,62.99 36.58,63.75 v1(37.47,63.75) ; v1(37.47,69.6) v1(37.47,75.44) ; v1(75.31,38.61) v1(75.31,50.29) v1(71.12,50.29) ; U10.11 v1(77.98,35.94) ; v1(30.23,83.44) R37.1 ; v1(57.02,50.29) v1(58.93,50.29)
  Bottom Layer w0.203: v1(57.02,50.29) 55.68,48.95 35.89,48.95 v1(35.18,49.66) ; v1(75.31,38.61) 77.47,38.61 77.98,38.1 v1(77.98,35.94) ; v1(37.47,75.44) 31.12,75.44 30.23,76.33 v1(30.23,83.44) ; v1(37.47,63.75) v1(37.47,69.6) ; v1(71.12,50.29) v1(58.93,50.29)
NSLEEP: length 161.9
  Top Layer w0.381: 11.81,27.3 11.81,24.64 11.18,24 8.64,24 8.13,23.5 R24.2
  PWR w0.508: H8.4 35.56,83.69 35.18,83.31 32.38,83.31 29.97,80.9 29.97,59.18 27.05,56.26 27.05,43.18 24.89,41.02 13.33,41.02 11.81,39.5 S2.3 10.29,27.3 9.53,28.07 9.53,29.97 8.76,30.73 5.21,30.73 4.44,29.97 4.44,25.27 8.13,21.59 8.13,18.92 11.18,15.88 19.94,15.88 22.1,18.03 26.54,18.03 27.81,16.76 46.86,16.76 48.01,15.62 H7.4
$1N429: length 19.5
  Top Layer w0.889: D1.1 15.13,13.08
  Bottom Layer w0.889: v1(15.13,13.22) 15.13,14.97 14.1,16 3.43,16 2.41,14.98 S1.3
$1N432: length 2.3
  Top Layer w0.889: Q1.1 v1(16.76,6.34)
$1N517: length 1.7
  Top Layer w0.889: LED1.2 20.4,8.5 R1.2
$1N6580: length 6.5
  Top Layer w0.508: 43.99,81.18 43.96,81.22 C25.2 41.21,81.22 40.29,82.14 C24.1 39.08,82.14 38.64,81.69 D7.1
$1N6622: length 1.7
  Top Layer w0.508: LED6.2 53.59,79.3 R23.2
$1N7021: length 6.3
  Top Layer w0.508: D8.1 40.49,18.29 C28.1 41.62,18.32 41.91,18.03 42.7,18.03 C29.2 43.01,18.22 U6.1
$1N10122: length 1.8
  Top Layer w0.381: LED7.2 11.34,21.62 R24.1
$1N19893: length 12.9
  Top Layer w0.762: U1.2 11.14,77.06 11.68,77.6 14.08,77.6 v1(14.1,77.61)
  Bottom Layer w0.508: 12.46,77.61 v1(14.1,77.61)
  Bottom Layer w0.762: v1(14.1,77.61) 16.4,77.61 16.97,78.18 L4.1
$1N25035: length 2
  Top Layer w0.762: U1.1 v1(8.94,80.77)
  vias: v1(9.78,68.71) v1(9.78,67.94) v1(9.78,67.06)
$1N25690: length 3.4
  Top Layer w0.381: R11.1 25.19,23.62 23.5,23.62 23.19,23.31 U2.6
$1N25691: length 5.7
  Top Layer w0.381: U2.7 22.53,21.5 21.99,20.95 21.97,20.95 21.6,20.58 R12.2 19.62,20.52 C12.1
$1N25693: length 5.8
  Top Layer w0.381: 19.94,25.83 21.89,25.83 R14.2 21.96,25.76 R15.2 21.88,23.8 21.88,22.04
$1N25694: length 1.9
  Top Layer w0.381: R13.2 27.41,25.38 C13.2
$1N25695: length 3.4
  Top Layer w0.381: U2.5 23.88,22.08 v1(23.88,22.86) ; v1(23.88,24.38) 24.01,24.52 R13.1
  Bottom Layer w0.381: v1(23.88,22.86) v1(23.88,24.38)
$1N25841: length 14
  Top Layer w0.381: v1(19.94,17.65) 22.51,17.65 22.54,17.63 ; R11.2 26.53,22.11 v1(26.54,22.1)
  Bottom Layer w0.381: v1(26.54,22.1) 24.13,22.1 22.86,20.83 20.32,20.83 19.94,20.45 v1(19.94,17.65)
  vias: v1(19.94,12.7) v1(20.7,12.7) v1(21.46,12.7)
$1N26497: length 12.5
  Top Layer w0.381: R17.1 28.31,40.5 v1(28.32,40.51) ; U4.6 24.2,43.81 24,43.81 23.62,44.2 23.62,45.59 23.88,45.85 v1(24.76,45.85)
  Bottom Layer w0.381: v1(28.32,40.51) 28.32,42.29 v1(24.76,45.85)
$1N26498: length 5.2
  Top Layer w0.381: C19.1 21.16,41.47 R18.2 22.34,41.52 22.73,41.91 23.37,41.91 23.55,42.1 U4.7
$1N26500: length 5.4
  Top Layer w0.381: C21.2 20.75,46.24 R20.2 22.65,46.18 R21.2 22.61,44.53 22.61,43.81 22.9,43.52 U4.8
$1N26501: length 2.2
  Top Layer w0.381: C20.2 28.18,44.7 R19.2
$1N26502: length 1.9
  Top Layer w0.381: R19.1 24.85,44.3 U4.5
$1N26503: length 1.6
  Top Layer w0.762: 19.55,55.88 21.13,55.88 LED5.2
$1N26528: length 8.9
  Top Layer w0.381: v1(26.92,37.85) 26.89,37.88 R17.2 ; 23.25,37.85 v1(21.21,37.85)
  Bottom Layer w0.381: v1(21.21,37.85) v1(26.92,37.85)
$1N27191: length 4.3
  Top Layer w0.381: v1(7.11,46.86) 8.08,46.86 R5.1 ; U3.6 v1(5.8,46.86)
  Bottom Layer w0.381: v1(5.8,46.86) v1(7.11,46.86)
$1N27192: length 5
  Top Layer w0.381: C5.1 3,44.01 R6.2 4.08,44.06 4.32,43.81 5.08,43.81 5.15,43.89 U3.7
$1N27194: length 5.8
  Top Layer w0.381: 4.5,46.66 4.43,46.74 ; 4.5,46.66 U3.8 ; 4.5,46.66 4.5,48.4 R8.2 2.66,48.45 C7.2
$1N27195: length 1.9
  Top Layer w0.381: R7.2 9.71,48.64 9.78,48.58
$1N27196: length 3.8
  Top Layer w0.381: U3.5 6.45,48.61 R7.1
$1N27244: length 11.4
  Top Layer w0.381: R5.2 8.13,45.31 v1(8.13,44.32) ; C4.2 v1(3.17,40.51)
  Bottom Layer w0.381: v1(3.17,40.51) 8,40.51 8.13,40.64 v1(8.13,44.32)
$1N27596: length 6.7
  Top Layer w0.508: D9.1 44.17,9.95 C32.1 45.14,9.97 45.59,9.52 46.31,9.52 ; 46.31,9.52 48.4,9.52 U7.1 ; 46.31,9.52 C33.2
$1N27726: length 1.8
  Top Layer w0.508: U8.3 41.39,13.99 R25.2
$2N831: length 9.3
  Top Layer w0.203: R35.1 R36.1
  Bottom Layer w0.203: 70.23,62.1 71.25,62.1 71.5,61.85 71.5,58.55 70.49,57.53 70.49,56.77 70.36,56.64 v1(69.72,56.64)
$2N3111: length 2.9
  Top Layer w0.203: Q2.1 38.37,52.85 38.74,53.21 39.14,53.21 R27.2
$2N3113: length 13.5
  Top Layer w0.381: Q2.3 40.51,51.45 v1(40.51,52.7)
  Bottom Layer w0.381: BUZZER1.2 48.77,51.47 48.77,53.47 48.39,53.84 D10.2 47.53,54.45 47.24,54.74 43.81,54.74 41.78,52.7 v1(40.51,52.7)
$2N15445: length 3.9
  Top Layer w0.203: 28.18,86.3 28.18,87.01 27.94,87.25 27.94,88 R38.1 ; 28.18,86.3 Q3.1 ; 28.18,86.3 R37.2
$2N16532: length 12.6
  Top Layer w0.508: Q3.3 27.19,84.33 28.32,84.33 29.08,83.57 v1(29.08,73.15)
  vias: v1(27.24,75.64) v1(27.24,74.34) v1(27.24,73.15) v1(34.42,73.53) v1(34.42,71.75)
$2N16605: length 2
  Top Layer w0.508: R39.1 v1(15.62,84.19)
  vias: v1(17.4,84.2) v1(19.3,84.2) v1(21.46,84.2)

## Copper pours and planes (outline as drawn; the poured copper is in the pictures)
+5V on Top Layer: 32.64,13.84 32.64,12.95 37.72,12.95 37.72,8.64 33.92,8.64 33.92,10.82 29.15,10.82 29.15,8.52 27.22,8.52 27.22,11.26 29.09,11.26 29.09,13.84
+8V_1 on Top Layer: 14.48,41.02 14.48,40 18.02,40 18.03,40 18.03,35.99 15.69,35.99 15.69,38.23 11.68,38.23 11.56,38.35 11.56,35.69 9.4,35.69 9.4,40.89 9.53,41.02
+8V_2 on Top Layer: 13.87,48.58 17.53,48.58 17.53,52.2 23.24,52.2 23.24,50.99 25.75,50.99 25.75,64.39 28.51,64.39 28.51,68.2 24.66,68.2 24.66,65.4 23.26,65.4 23.26,57.93 23.24,57.91 24.49,57.91 24.49,54.46 24.38,54.36 17.14,54.36 17.14,54.36 16.51,54.36 16.51,51.18 14.1,51.18 13.87,50.95
+8V_2 on Bottom Layer: 30.48,76.75 30.48,80.59 36.31,80.59 36.31,76.74 30.48,76.74
GND on Top Layer: 23.5,18.54 23.62,18.54 23.62,20.32 24.13,20.32 24.13,20.32 24.13,18.54 24.85,18.54 24.85,16.57 27.4,16.57 27.4,13.08 23.5,13.08
GND on Top Layer: 10.29,62.14 19.76,62.14 19.76,58.87 19.69,58.8 10.29,58.8
GND on Top Layer: 25.4,89.03 27.18,89.03 27.18,85.36 25.42,85.36 25.4,85.34
GND on Top Layer: 6.23,43.32 7.01,43.32 7.01,39.06 9.17,39.06 9.17,36.16 5.68,36.16 5.68,41.4 6.23,41.4
GND on Top Layer: 6.22,92.58 88.39,92.58 88.39,-3.18 16.26,-3.18 16.26,31.24 6.6,31.24 6.48,31.37 6.48,92.33
GND on Top Layer: 17.07,19.83 21.25,19.83 21.25,20.46 22.12,20.46 22.12,18.59 17.07,18.59
GND on Top Layer: 24.65,41.53 25.27,41.53 25.27,36.96 28.43,36.96 28.43,33.4 24.26,33.4 24.26,38.99 24.65,38.99
GND on Top Layer: 12.06,37.85 15.05,37.85 15.05,35.94 12.06,35.94 12.06,37.84
GND on Top Layer: 18.72,40.77 22.42,40.77 22.42,41.22 22.48,41.27 23.19,41.27 23.19,39.26 18.72,39.26
GND on Top Layer: 0.48,43.31 4.75,43.31 4.75,41.59 0.5,41.59 0.48,41.6
GND on Top Layer: 17.83,51.19 22.88,51.19 22.88,49.68 22.86,49.66 17.77,49.66 17.77,51.12
GND on Top Layer: 29.97,10.79 33.17,10.79 33.17,8.53 29.97,8.53
GND on Bottom Layer: 6.22,92.84 88.39,92.84 88.39,-2.92 16.26,-2.92 16.26,5.39 17.68,5.39 17.68,31.37 6.22,31.37
GND on GND: 6.22,92.58 88.39,92.58 88.39,-3.18 41.4,-3.18 41.4,7.49 24.26,7.49 24.26,9.49 16.29,9.49 16.26,9.52 16.26,31.24 6.41,31.24 6.41,92.4
GNDBAT on Top Layer: 13.21,30.86 15.88,30.86 15.88,17.27 13.97,17.27 13.97,28.24 13.21,28.24
GNDBAT on Top Layer: -1.91,92.58 6.22,92.58 6.22,30.99 16.26,30.99 16.26,-3.18 -1.91,-3.18
GNDBAT on Bottom Layer: -1.91,92.58 6.22,92.58 6.22,30.99 16.26,30.99 16.26,-3.05 -1.91,-3.05
GNDBAT on GND: -1.91,92.58 6.22,92.58 6.22,31.11 16.11,31.11 16.11,9.4 24.13,9.4 24.13,7.4 41.11,7.4 41.15,7.37 41.15,-2.06 -1.91,-2.06
VCCBAT on Top Layer: 24.83,32.8 28.12,32.8 28.12,30.14 24.82,30.14 24.82,32.8
VCCBAT on Top Layer: 21.84,0.51 21.84,7.4 23.97,7.4 24,7.37 24,12.61 26.92,12.61 26.92,7.37 36.64,7.37 36.64,0.51 36.63,0.51
VCCBAT on Top Layer: 24.26,9.52 17.78,9.52 17.78,7.64 16.39,7.64 16.39,9.52 17.04,9.52 17.04,10.06 24.16,10.06 24.26,10.16
VCCBAT on Top Layer: 6.24,35.6 9.23,35.6 9.23,32.99 6.25,32.99 6.22,33.02 6.22,35.58
VCCBAT on Top Layer: 6.6,64.9 9.65,64.9 9.65,61.85 6.56,61.85 6.56,64.85
VCCBAT on PWR: -1.91,92.58 88.39,92.58 88.39,-3.18 -1.91,-3.18
$1N429 on Top Layer: 16.3,9.52 16.3,12.38 13.92,12.38 13.92,9.52
